# Altium schematic sheet mainboard.schdoc (part 1 of 2) (continued)
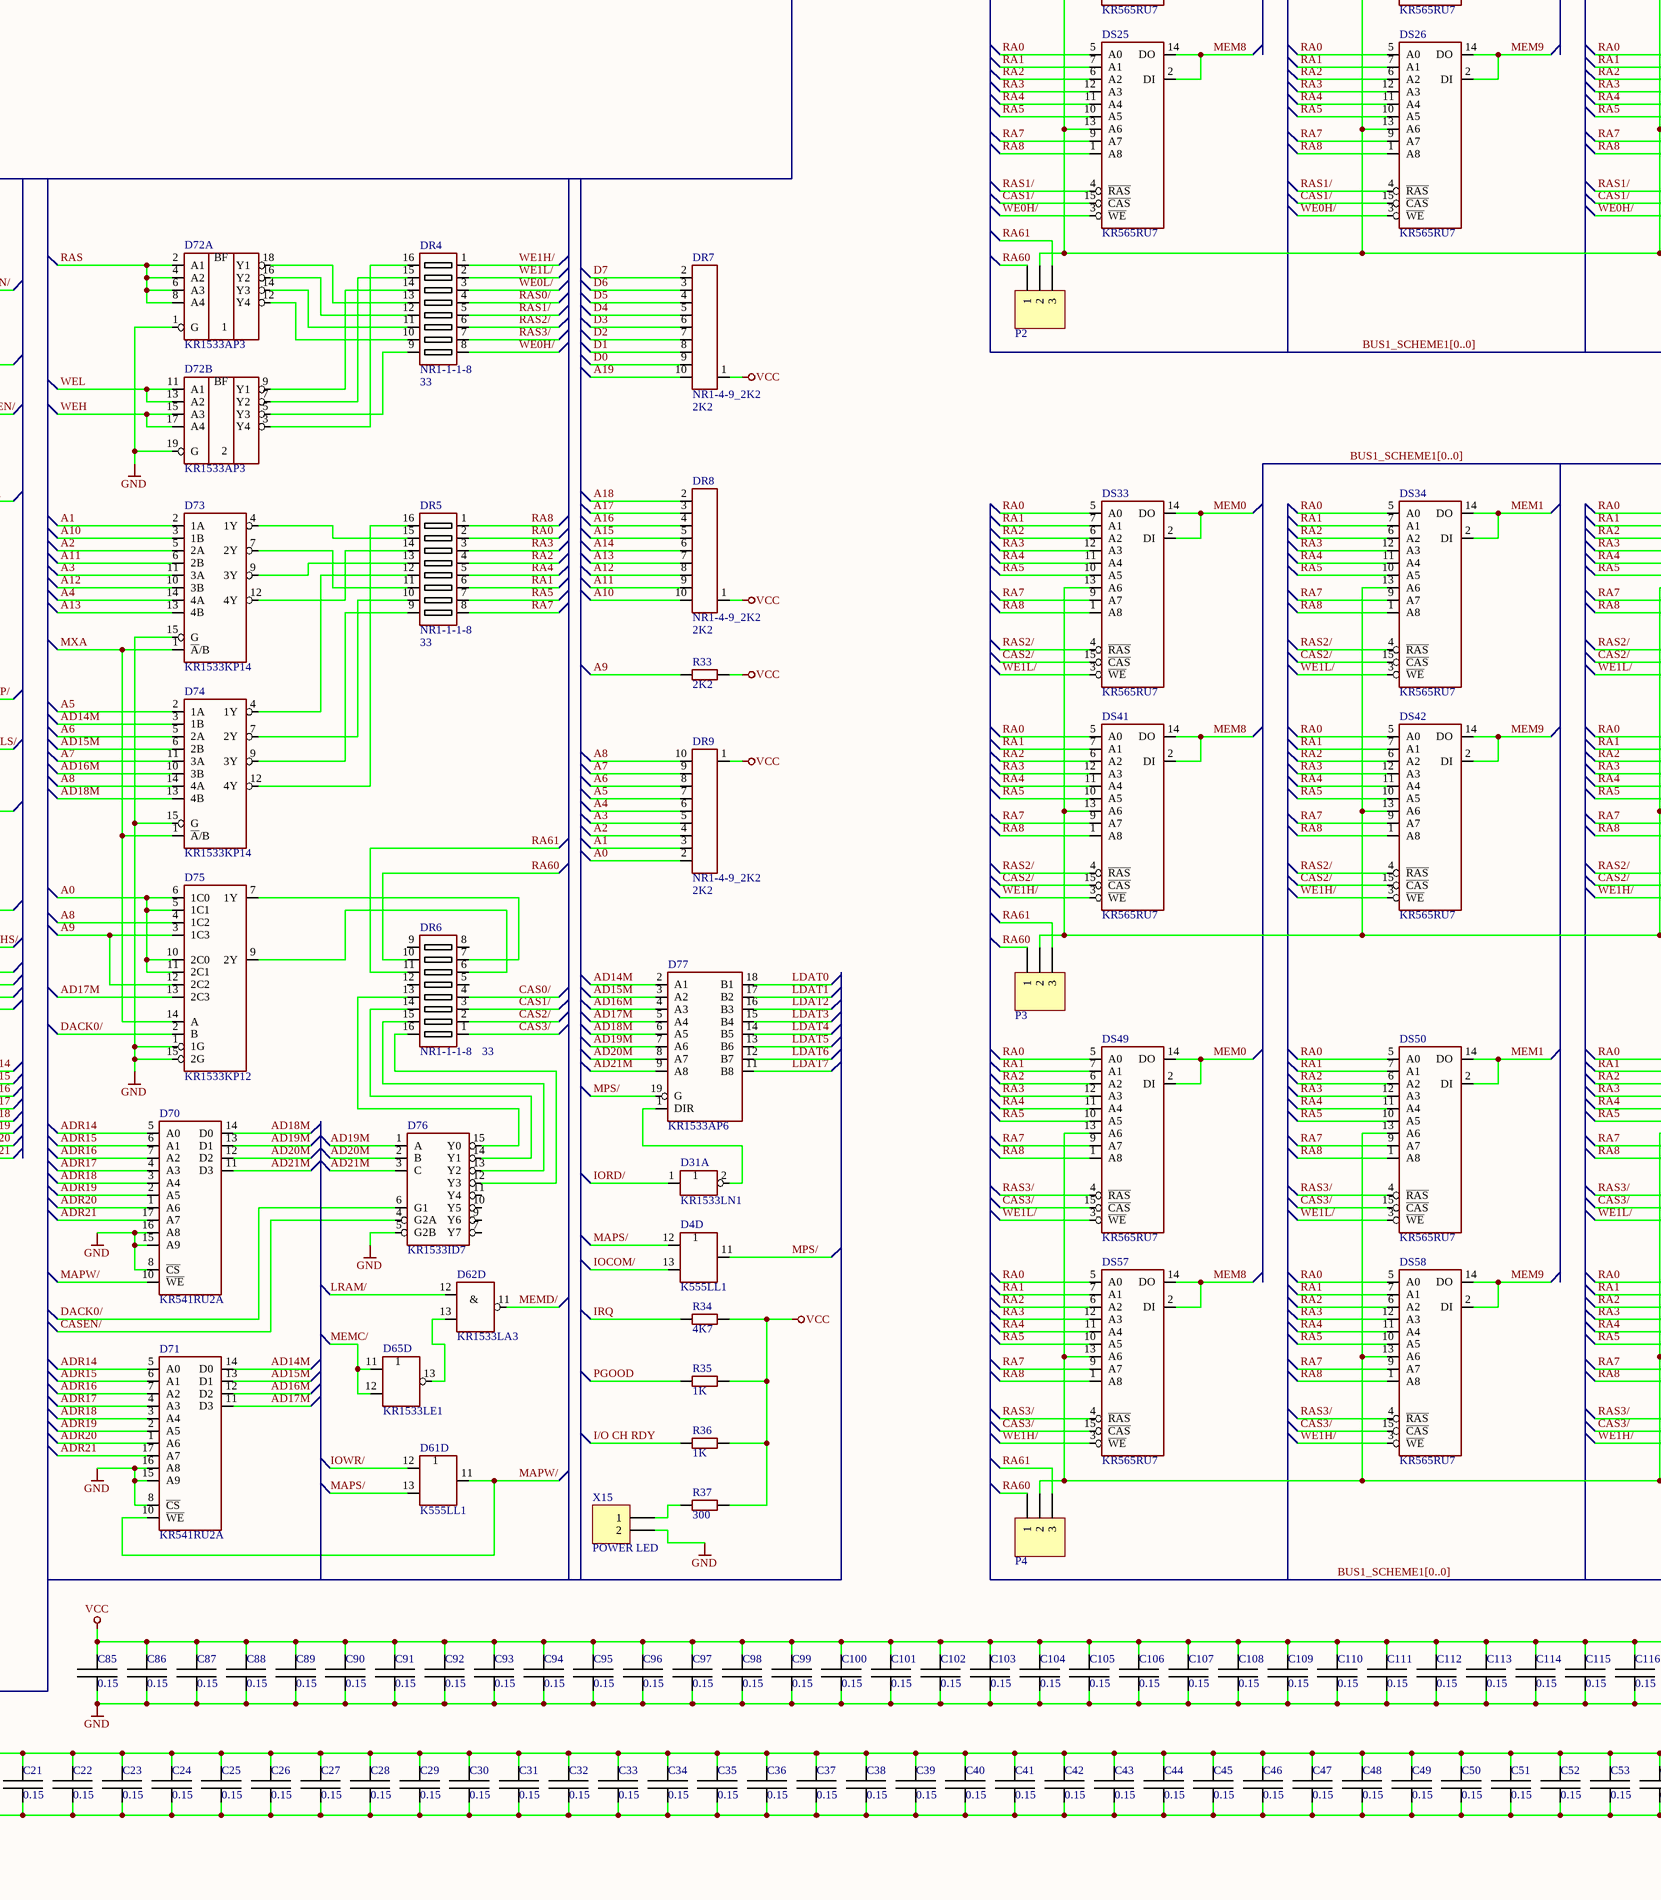
[diagram p4: mainboard.schdoc, bottom middle]
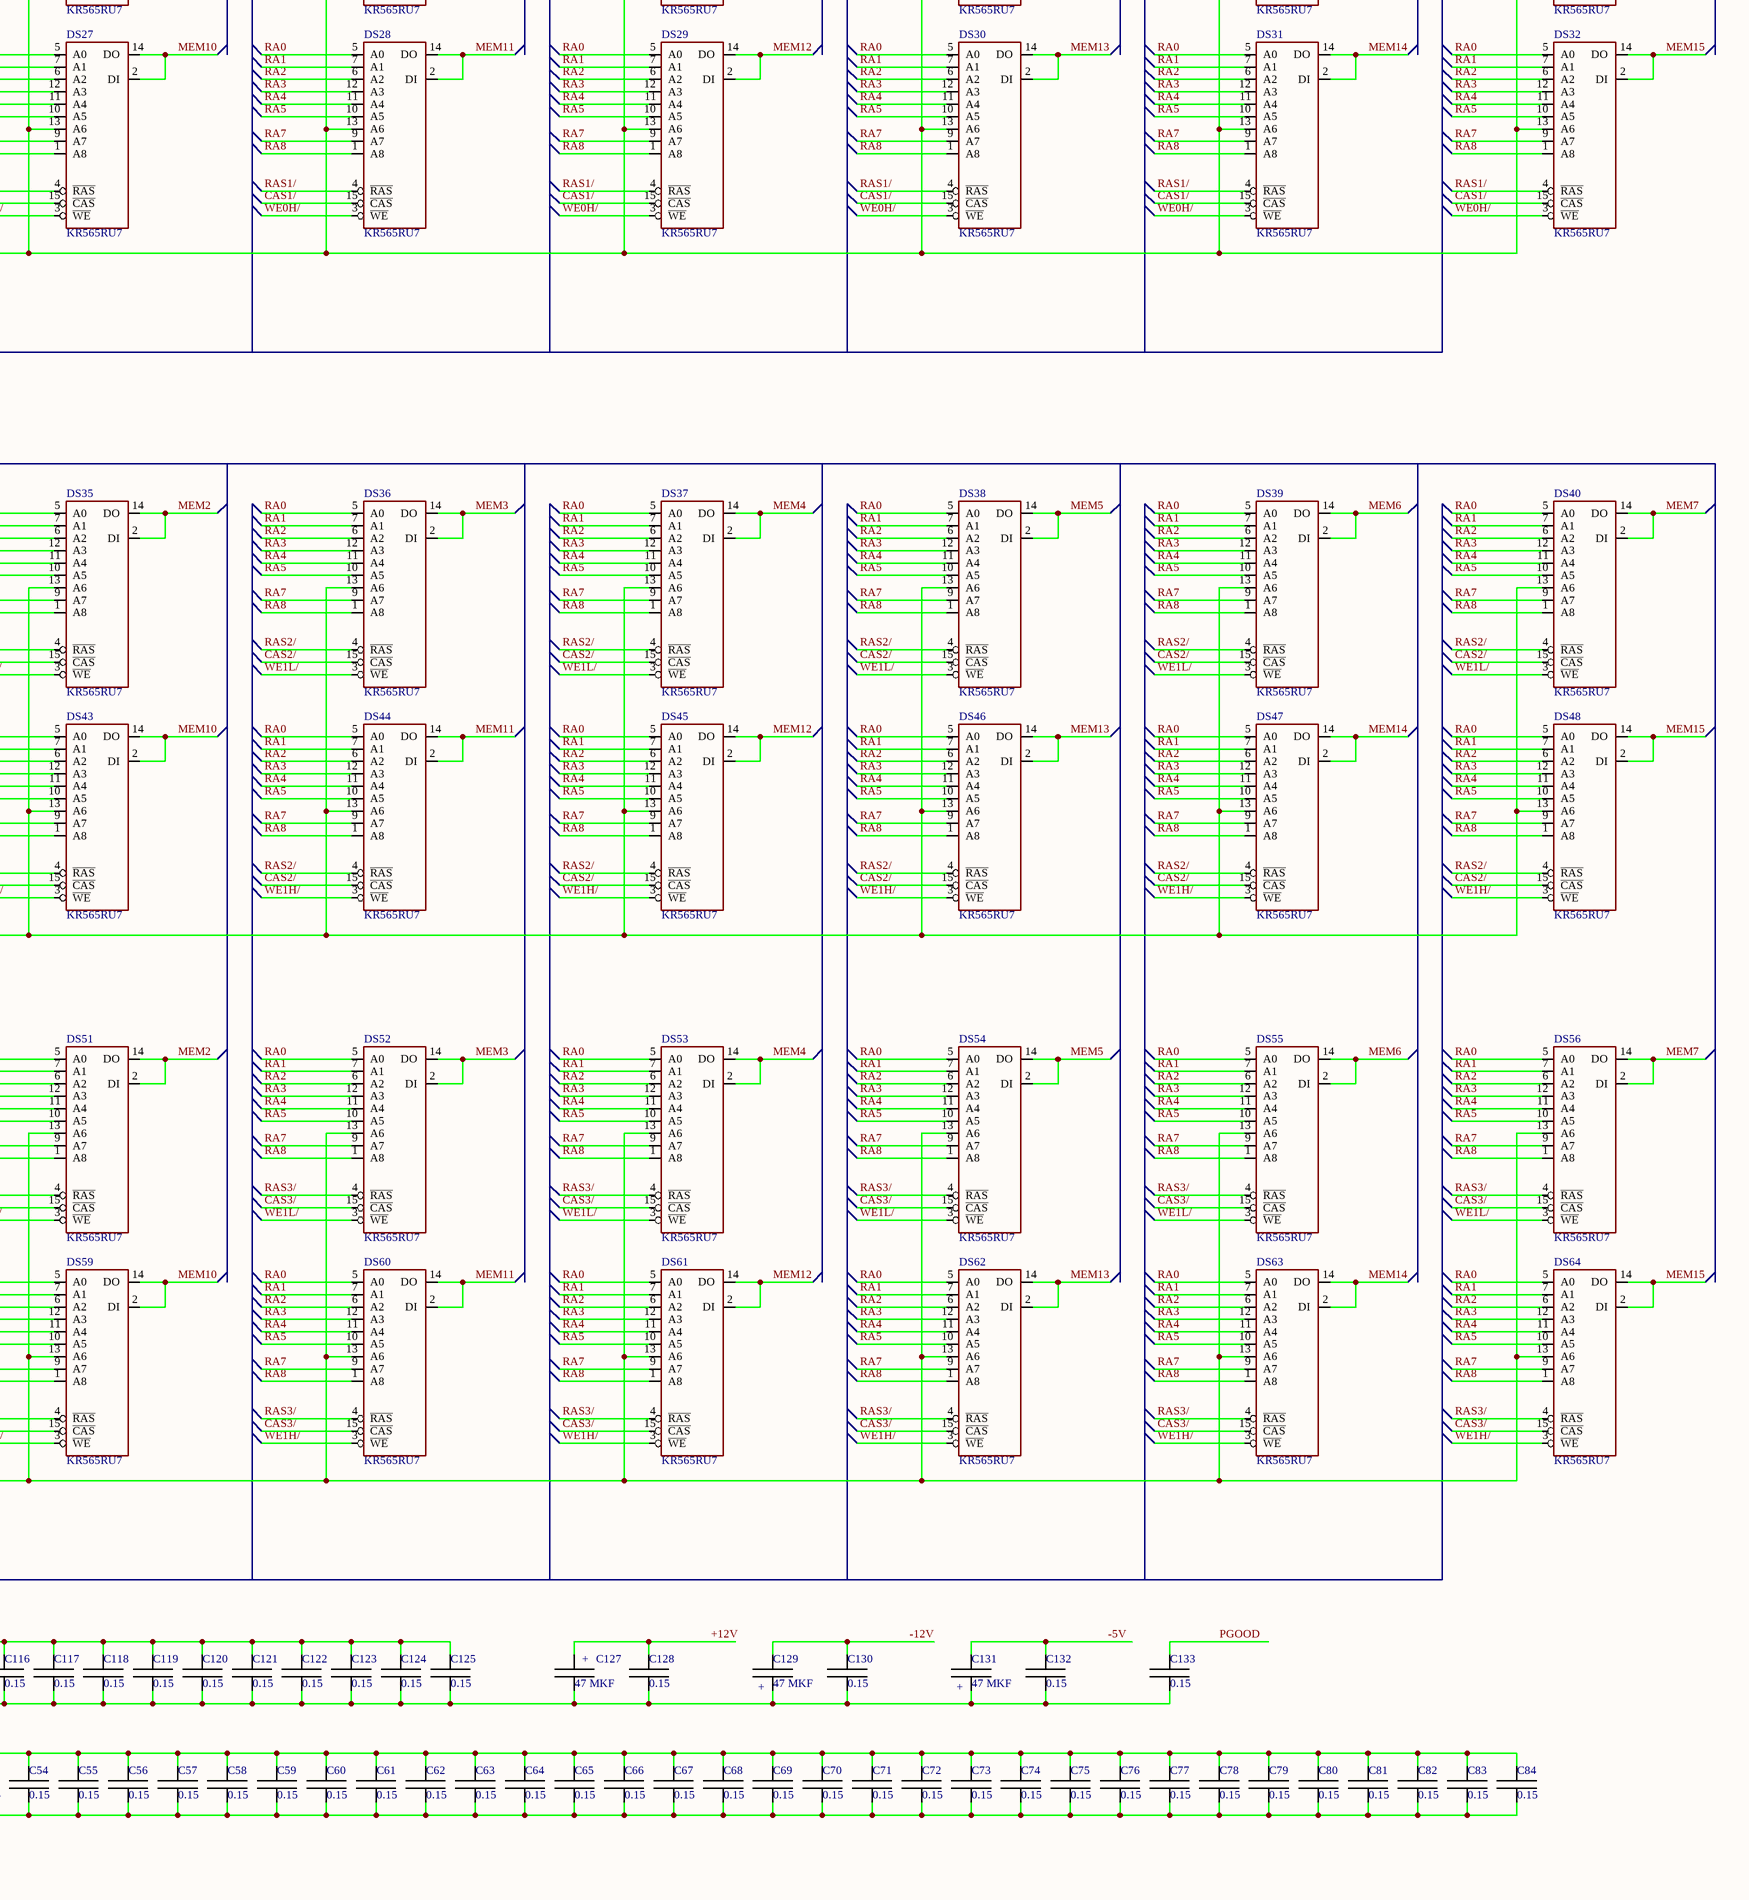
[diagram p5: mainboard.schdoc, bottom right]

## Parts
BT1  BATTERY_6V  [BATTERY_6V]
C1  16pF  [Cap_5mm]
C2  value 39pF  [CAP_2.5MM]  (hidden comment: CAP_39)
C3  22pF  [CAP_2.5MM]
C4  22pF  [CAP_2.5MM]
C5  value 10 MKF  [CAP_20MM_P]  (hidden comment: CAP_10MKF)
C6  6n8  [CAP_2.5MM]
C7  6n8  [CAP_2.5MM]
C8  value 47 MKF  [CAP_25MM_P]  (hidden comment: CAP_47MKF)
C10  value 0.15  [Cap_5mm]  (hidden comment: CAP_0.15)
C11  value 0.15  [Cap_5mm]  (hidden comment: CAP_0.15)
C12  value 0.15  [Cap_5mm]  (hidden comment: CAP_0.15)
C13  value 0.15  [Cap_5mm]  (hidden comment: CAP_0.15)
C14  value 0.15  [Cap_5mm]  (hidden comment: CAP_0.15)
C15  value 0.15  [Cap_5mm]  (hidden comment: CAP_0.15)
C16  value 0.15  [Cap_5mm]  (hidden comment: CAP_0.15)
C17  value 0.15  [Cap_5mm]  (hidden comment: CAP_0.15)
C18  value 0.15  [Cap_5mm]  (hidden comment: CAP_0.15)
C19  value 0.15  [Cap_5mm]  (hidden comment: CAP_0.15)
C20  value 0.15  [Cap_5mm]  (hidden comment: CAP_0.15)
C21  value 0.15  [Cap_5mm]  (hidden comment: CAP_0.15)
C22  value 0.15  [Cap_5mm]  (hidden comment: CAP_0.15)
C23  value 0.15  [Cap_5mm]  (hidden comment: CAP_0.15)
C24  value 0.15  [Cap_5mm]  (hidden comment: CAP_0.15)
C25  value 0.15  [Cap_5mm]  (hidden comment: CAP_0.15)
C26  value 0.15  [Cap_5mm]  (hidden comment: CAP_0.15)
C27  value 0.15  [Cap_5mm]  (hidden comment: CAP_0.15)
C28  value 0.15  [Cap_5mm]  (hidden comment: CAP_0.15)
C29  value 0.15  [Cap_5mm]  (hidden comment: CAP_0.15)
C30  value 0.15  [Cap_5mm]  (hidden comment: CAP_0.15)
C31  value 0.15  [Cap_5mm]  (hidden comment: CAP_0.15)
C32  value 0.15  [Cap_5mm]  (hidden comment: CAP_0.15)
C33  value 0.15  [Cap_5mm]  (hidden comment: CAP_0.15)
C34  value 0.15  [Cap_5mm]  (hidden comment: CAP_0.15)
C35  value 0.15  [Cap_5mm]  (hidden comment: CAP_0.15)
C36  value 0.15  [Cap_5mm]  (hidden comment: CAP_0.15)
C37  value 0.15  [Cap_5mm]  (hidden comment: CAP_0.15)
C38  value 0.15  [Cap_5mm]  (hidden comment: CAP_0.15)
C39  value 0.15  [Cap_5mm]  (hidden comment: CAP_0.15)
C40  value 0.15  [Cap_5mm]  (hidden comment: CAP_0.15)
C41  value 0.15  [Cap_5mm]  (hidden comment: CAP_0.15)
C42  value 0.15  [Cap_5mm]  (hidden comment: CAP_0.15)
C43  value 0.15  [Cap_5mm]  (hidden comment: CAP_0.15)
C44  value 0.15  [Cap_5mm]  (hidden comment: CAP_0.15)
C45  value 0.15  [Cap_5mm]  (hidden comment: CAP_0.15)
C46  value 0.15  [Cap_5mm]  (hidden comment: CAP_0.15)
C47  value 0.15  [Cap_5mm]  (hidden comment: CAP_0.15)
C48  value 0.15  [Cap_5mm]  (hidden comment: CAP_0.15)
C49  value 0.15  [Cap_5mm]  (hidden comment: CAP_0.15)
C50  value 0.15  [Cap_5mm]  (hidden comment: CAP_0.15)
C51  value 0.15  [Cap_5mm]  (hidden comment: CAP_0.15)
C52  value 0.15  [Cap_5mm]  (hidden comment: CAP_0.15)
C53  value 0.15  [Cap_5mm]  (hidden comment: CAP_0.15)
C54  value 0.15  [Cap_5mm]  (hidden comment: CAP_0.15)
C55  value 0.15  [Cap_5mm]  (hidden comment: CAP_0.15)
C56  value 0.15  [Cap_5mm]  (hidden comment: CAP_0.15)
C57  value 0.15  [Cap_5mm]  (hidden comment: CAP_0.15)
C58  value 0.15  [Cap_5mm]  (hidden comment: CAP_0.15)
C59  value 0.15  [Cap_5mm]  (hidden comment: CAP_0.15)
C60  value 0.15  [Cap_5mm]  (hidden comment: CAP_0.15)
C61  value 0.15  [Cap_5mm]  (hidden comment: CAP_0.15)
C62  value 0.15  [Cap_5mm]  (hidden comment: CAP_0.15)
C63  value 0.15  [Cap_5mm]  (hidden comment: CAP_0.15)
C64  value 0.15  [Cap_5mm]  (hidden comment: CAP_0.15)
C65  value 0.15  [Cap_5mm]  (hidden comment: CAP_0.15)
C66  value 0.15  [Cap_5mm]  (hidden comment: CAP_0.15)
C67  value 0.15  [Cap_5mm]  (hidden comment: CAP_0.15)
C68  value 0.15  [Cap_5mm]  (hidden comment: CAP_0.15)
C69  value 0.15  [Cap_5mm]  (hidden comment: CAP_0.15)
C70  value 0.15  [Cap_5mm]  (hidden comment: CAP_0.15)
C71  value 0.15  [Cap_5mm]  (hidden comment: CAP_0.15)
C72  value 0.15  [Cap_5mm]  (hidden comment: CAP_0.15)
C73  value 0.15  [Cap_5mm]  (hidden comment: CAP_0.15)
C74  value 0.15  [Cap_5mm]  (hidden comment: CAP_0.15)
C75  value 0.15  [Cap_5mm]  (hidden comment: CAP_0.15)
C76  value 0.15  [Cap_5mm]  (hidden comment: CAP_0.15)
C77  value 0.15  [Cap_5mm]  (hidden comment: CAP_0.15)
C78  value 0.15  [Cap_5mm]  (hidden comment: CAP_0.15)
C79  value 0.15  [Cap_5mm]  (hidden comment: CAP_0.15)
C80  value 0.15  [Cap_5mm]  (hidden comment: CAP_0.15)
C81  value 0.15  [Cap_5mm]  (hidden comment: CAP_0.15)
C82  value 0.15  [Cap_5mm]  (hidden comment: CAP_0.15)
C83  value 0.15  [Cap_5mm]  (hidden comment: CAP_0.15)
C84  value 0.15  [Cap_5mm]  (hidden comment: CAP_0.15)
C85  value 0.15  [Cap_5mm]  (hidden comment: CAP_0.15)
C86  value 0.15  [Cap_5mm]  (hidden comment: CAP_0.15)
C87  value 0.15  [Cap_5mm]  (hidden comment: CAP_0.15)
C88  value 0.15  [Cap_5mm]  (hidden comment: CAP_0.15)
C89  value 0.15  [Cap_5mm]  (hidden comment: CAP_0.15)
C90  value 0.15  [Cap_5mm]  (hidden comment: CAP_0.15)
C91  value 0.15  [Cap_5mm]  (hidden comment: CAP_0.15)
C92  value 0.15  [Cap_5mm]  (hidden comment: CAP_0.15)
C93  value 0.15  [Cap_5mm]  (hidden comment: CAP_0.15)
C94  value 0.15  [Cap_5mm]  (hidden comment: CAP_0.15)
C95  value 0.15  [Cap_5mm]  (hidden comment: CAP_0.15)
C96  value 0.15  [Cap_5mm]  (hidden comment: CAP_0.15)
C97  value 0.15  [Cap_5mm]  (hidden comment: CAP_0.15)
C98  value 0.15  [Cap_5mm]  (hidden comment: CAP_0.15)
C99  value 0.15  [Cap_5mm]  (hidden comment: CAP_0.15)
C100  value 0.15  [Cap_5mm]  (hidden comment: CAP_0.15)
C101  value 0.15  [Cap_5mm]  (hidden comment: CAP_0.15)
C102  value 0.15  [Cap_5mm]  (hidden comment: CAP_0.15)
C103  value 0.15  [Cap_5mm]  (hidden comment: CAP_0.15)
C104  value 0.15  [Cap_5mm]  (hidden comment: CAP_0.15)
C105  value 0.15  [Cap_5mm]  (hidden comment: CAP_0.15)
C106  value 0.15  [Cap_5mm]  (hidden comment: CAP_0.15)
C107  value 0.15  [Cap_5mm]  (hidden comment: CAP_0.15)
C108  value 0.15  [Cap_5mm]  (hidden comment: CAP_0.15)
C109  value 0.15  [Cap_5mm]  (hidden comment: CAP_0.15)
C110  value 0.15  [Cap_5mm]  (hidden comment: CAP_0.15)
C111  value 0.15  [Cap_5mm]  (hidden comment: CAP_0.15)
C112  value 0.15  [Cap_5mm]  (hidden comment: CAP_0.15)
C113  value 0.15  [Cap_5mm]  (hidden comment: CAP_0.15)
C114  value 0.15  [Cap_5mm]  (hidden comment: CAP_0.15)
C115  value 0.15  [Cap_5mm]  (hidden comment: CAP_0.15)
C116  value 0.15  [Cap_5mm]  (hidden comment: CAP_0.15)
C117  value 0.15  [Cap_5mm]  (hidden comment: CAP_0.15)
C118  value 0.15  [Cap_5mm]  (hidden comment: CAP_0.15)
C119  value 0.15  [Cap_5mm]  (hidden comment: CAP_0.15)
C120  value 0.15  [Cap_5mm]  (hidden comment: CAP_0.15)
C121  value 0.15  [Cap_5mm]  (hidden comment: CAP_0.15)
C122  value 0.15  [Cap_5mm]  (hidden comment: CAP_0.15)
C123  value 0.15  [Cap_5mm]  (hidden comment: CAP_0.15)
C124  value 0.15  [Cap_5mm]  (hidden comment: CAP_0.15)
C125  value 0.15  [Cap_5mm]  (hidden comment: CAP_0.15)
C127  value 47 MKF  [CAP_25MM_P]  (hidden comment: CAP_47MKF)
C128  value 0.15  [Cap_5mm]  (hidden comment: CAP_0.15)
C129  value 47 MKF  [CAP_25MM_P]  (hidden comment: CAP_47MKF)
C130  value 0.15  [Cap_5mm]  (hidden comment: CAP_0.15)
C131  value 47 MKF  [CAP_25MM_P]  (hidden comment: CAP_47MKF)
C132  value 0.15  [Cap_5mm]  (hidden comment: CAP_0.15)
C133  value 0.15  [Cap_5mm]  (hidden comment: CAP_0.15)
C134  value 0.15  [Cap_5mm]  (hidden comment: CAP_0.15)
D1  KR1533TM2  [DIP14]  (parts A,B of 2)
D2  KR1533LA1  [DIP14]  (parts A,B of 2)
D3  KR1533LI1  [DIP14]  (parts A,B,C,D of 4)
D4  K555LL1  [DIP14]  (parts A,C,D of 4)
D5  KR1533TM2  [DIP14]  (parts A,B of 2)
D6  KR1533TM2  [DIP14]  (parts A,B of 2)
D7  KR1533LN1  [DIP14]  (parts C,D,E of 6)
D8  KR1533IE10  [DIP16]
D9  KR1533TM9  [DIP16]
D10  KR1533TM2  [DIP14]  (parts A,B of 2)
D11  KR1533LN1  [DIP14]  (parts A,C of 6)
D12  KR556RT4A  [DIP16]
D13  KR1810GF84  [DIP18]
D14  KR1533LA3  [DIP14]  (parts A,B,C,D of 4)
D15  KR1533LE1  [DIP14]  (parts A,B,C,D of 4)
D16  KR531LN1  [DIP14]  (parts A,B,C,D of 6)
D17  KR1533LI1  [DIP14]  (parts A,B,C,D of 4)
D18  K555LL1  [DIP14]  (parts A,D of 4)
D19  KR531TM2  [DIP14]  (parts A,B of 2)
D20  KR1533TM8  [DIP16]
D21  KR1810VM86M  [DIP40]
D22  KR1810VM87  [DIP40]
D23  KR1533LN1  [DIP14]  (parts A,B,C,D,F of 6)
D24  KR1533LP8  [DIP14]  (parts B,C,D of 4)
D25  KR1533AP5  [DIP20]
D26  KR1533AP6  [DIP20]
D27  KR1533IR22  [DIP20]
D28  KR1533IR22  [DIP20]
D29  KR1533IR22  [DIP20]
D30  KR1810VG88  [DIP20]
D31  KR1533LN1  [DIP14]  (parts A,B,C,D,E,F of 6)
D32  KR556RT4A  [DIP16]
D33  KR1533IR22  [DIP20]
D34  KR1533LI1  [DIP14]  (parts B,D of 4)
D35  KR1533TM2  [DIP14]  (parts A,B of 2)
D36  KR1533TM2  [DIP14]  (parts A,B of 2)
D37  155LA13  [DIP14]  (parts A,B,C,D of 4)
D38  KR1533IR24  [DIP20]
D39  K155IE4  [DIP14]
D40  KR1810VN59A  [DIP28]
D41  KR1533AP6  [DIP20]
D42  K555LL1  [DIP14]  (parts A,B,C,D of 4)
D43  KR1533AP6  [DIP20]
D44  K155ID3  [DIP24]
D45  KR580VV55A  [DIP40]
D46  KR1533AP6  [DIP20]
D47  KR1810VT37  [DIP40]
D48  KM555IR26  [DIP16]
D49  580VI53  [DIP24]
D50  K561LN2  [DIP14]  (parts A,B,C,E,F of 6)
D51  KR1533AP5  [DIP20]
D52  KR1533IR22  [DIP20]
D53  KR1533AP5  [DIP20]
D54  KR512VI1  [DIP24]
D55  KR556RT4A  [DIP16]
D56  KR1533AP6  [DIP20]
D57  KR1533AP6  [DIP20]
D58  KR1533AP6  [DIP20]
D59  27256  [DIP28]
D60  27256  [DIP28]
D61  K555LL1  [DIP14]  (parts A,B,C,D of 4)
D62  KR1533LA3  [DIP14]  (parts A,B,C,D of 4)
D63  KR1533LI1  [DIP14]  (parts A,B,D of 4)
D64  K555LL1  [DIP14]  (parts A,B,C,D of 4)
D65  KR1533LE1  [DIP14]  (parts A,B,C,D of 4)
D66  KR1533TM9  [DIP16]
D67  KR1533AP5  [DIP20]
D68  KM555IR26  [DIP16]
D69  KM555IR26  [DIP16]
D70  KR541RU2A  [DIP18]
D71  KR541RU2A  [DIP18]
D72  KR1533AP3  [DIP20]  (parts A,B of 2)
D73  KR1533KP14  [DIP16]
D74  KR1533KP14  [DIP16]
D75  KR1533KP12  [DIP16]
D76  KR1533ID7  [DIP16]
D77  KR1533AP6  [DIP20]
DR1  NR1-4-9_680  value 680  [NR1-4-9]
DR2  NR1-4-9_680  value 680  [NR1-4-9]
DR3  NR1-4-9_4K7  value 4K7  [NR1-4-9]
DR4  NR1-1-1-8  value 33  [DIP16]
DR5  NR1-1-1-8  value 33  [DIP16]
DR6  NR1-1-1-8  value 33  [DIP16]
DR7  NR1-4-9_2K2  value 2K2  [NR1-4-9ENG]
DR8  NR1-4-9_2K2  value 2K2  [NR1-4-9ENG]
DR9  NR1-4-9_2K2  value 2K2  [NR1-4-9ENG]
DS1  KR565RU7  [DIP16]
DS2  KR565RU7  [DIP16]
DS3  KR565RU7  [DIP16]
DS4  KR565RU7  [DIP16]
DS5  KR565RU7  [DIP16]
DS6  KR565RU7  [DIP16]
DS7  KR565RU7  [DIP16]
DS8  KR565RU7  [DIP16]
DS9  KR565RU7  [DIP16]
DS10  KR565RU7  [DIP16]
DS11  KR565RU7  [DIP16]
DS12  KR565RU7  [DIP16]
DS13  KR565RU7  [DIP16]
DS14  KR565RU7  [DIP16]
DS15  KR565RU7  [DIP16]
DS16  KR565RU7  [DIP16]
DS17  KR565RU7  [DIP16]
DS18  KR565RU7  [DIP16]
DS19  KR565RU7  [DIP16]
DS20  KR565RU7  [DIP16]
DS21  KR565RU7  [DIP16]
DS22  KR565RU7  [DIP16]
DS23  KR565RU7  [DIP16]
DS24  KR565RU7  [DIP16]
DS25  KR565RU7  [DIP16]
DS26  KR565RU7  [DIP16]
DS27  KR565RU7  [DIP16]
DS28  KR565RU7  [DIP16]
DS29  KR565RU7  [DIP16]
DS30  KR565RU7  [DIP16]
DS31  KR565RU7  [DIP16]
DS32  KR565RU7  [DIP16]
DS33  KR565RU7  [DIP16]
DS34  KR565RU7  [DIP16]
DS35  KR565RU7  [DIP16]
DS36  KR565RU7  [DIP16]
DS37  KR565RU7  [DIP16]
DS38  KR565RU7  [DIP16]
DS39  KR565RU7  [DIP16]
DS40  KR565RU7  [DIP16]
DS41  KR565RU7  [DIP16]
DS42  KR565RU7  [DIP16]
DS43  KR565RU7  [DIP16]
DS44  KR565RU7  [DIP16]
DS45  KR565RU7  [DIP16]
DS46  KR565RU7  [DIP16]
DS47  KR565RU7  [DIP16]
DS48  KR565RU7  [DIP16]
DS49  KR565RU7  [DIP16]
DS50  KR565RU7  [DIP16]
DS51  KR565RU7  [DIP16]
DS52  KR565RU7  [DIP16]
DS53  KR565RU7  [DIP16]
DS54  KR565RU7  [DIP16]
DS55  KR565RU7  [DIP16]
DS56  KR565RU7  [DIP16]
DS57  KR565RU7  [DIP16]
DS58  KR565RU7  [DIP16]
DS59  KR565RU7  [DIP16]
DS60  KR565RU7  [DIP16]
DS61  KR565RU7  [DIP16]
DS62  KR565RU7  [DIP16]
DS63  KR565RU7  [DIP16]
DS64  KR565RU7  [DIP16]
P1  Header 3  [HDR1X3]  (value not drawn)
P2  Header 3  [HDR1X3]  (value not drawn)
P3  Header 3  [HDR1X3]  (value not drawn)
P4  Header 3  [HDR1X3]  (value not drawn)
Q1  value 24 MHz  [XTAL_24MHZ]  (hidden comment: XTAL_24MHZ)
Q2  value 14.318 KHz  [XTAL_24MHZ]  (hidden comment: XTAL_14318)
Q3  value 32.768 KHz  [XTAL32768]  (hidden comment: XTAL_32768)
R1  value 1K  [RES_10MM]  (hidden comment: RES_1K)
R2  value 1K  [RES_10MM]  (hidden comment: RES_1K)
R3  value 1K  [RES_10MM]  (hidden comment: RES_1K)
R4  value 1K  [RES_10MM]  (hidden comment: RES_1K)
R5  value 750  [RES_10MM]  (hidden comment: RES_750)
R6  value 750  [RES_10MM]  (hidden comment: RES_750)
R7  value 4K7  [RES_10MM]  (hidden comment: RES_4K7)
R8  value 4K7  [RES_10MM]  (hidden comment: RES_4K7)
R9  value 4K7  [RES_10MM]  (hidden comment: RES_4K7)
R10  value 4K7  [RES_10MM]  (hidden comment: RES_4K7)
R11  value 390  [RES_10MM]  (hidden comment: RES_390)
R12  value 1K  [RES_10MM]  (hidden comment: RES_1K)
R13  value 1K  [RES_10MM]  (hidden comment: RES_1K)
R14  value 1K  [RES_10MM]  (hidden comment: RES_1K)
R15  value 1K  [RES_10MM]  (hidden comment: RES_1K)
R16  value 390  [RES_10MM]  (hidden comment: RES_390)
R17  value 10K  [RES_10MM]  (hidden comment: RES_10K)
R18  value 10K  [RES_10MM]  (hidden comment: RES_10K)
R19  value 100  [RES_10MM]  (hidden comment: RES_100)
R20  value 51K  [RES_10MM]  (hidden comment: RES_51K)
R21  value 10K  [RES_10MM]  (hidden comment: RES_10K)
R22  value 5M1  [RES_12.5MM]  (hidden comment: RES_5M1)
R23  value 1K  [RES_10MM]  (hidden comment: RES_1K)
R24  value 470K  [RES_10MM]  (hidden comment: RES_470K)
R25  value 4K7  [RES_10MM]  (hidden comment: RES_4K7)
R26  value 10K  [RES_10MM]  (hidden comment: RES_10K)
R27  value 1K  [RES_10MM]  (hidden comment: RES_1K)
R28  value 680  [RES_10MM]  (hidden comment: RES_680)
R29  value 680  [RES_10MM]  (hidden comment: RES_680)
R30  value 680  [RES_10MM]  (hidden comment: RES_680)
R31  value 680  [RES_10MM]  (hidden comment: RES_680)
R32  value 1K  [RES_10MM]  (hidden comment: RES_1K)
R33  value 2K2  [RES_10MM]  (hidden comment: RES_2K2)
R34  value 4K7  [RES_10MM]  (hidden comment: RES_4K7)
R35  value 1K  [RES_10MM]  (hidden comment: RES_1K)
R36  value 1K  [RES_10MM]  (hidden comment: RES_1K)
R37  value 300  [RES_10MM]  (hidden comment: RES_300)
R38  value 1K  [RES_10MM]  (hidden comment: RES_1K)
S1  Header 2X2  [HDR2X2]
S6  HEADER4X2  [HEADER4X2]  (value not drawn)
S7  Header 2  [HDR1X2]
VD1  KD522A  [DIOD_12.5]
VD2  KD522A  [DIOD_12.5]
VT1  KT361A  [TRANS]
VT2  KT315G  [TRANS]
X1  RESET  [HDR1X2]
X2  SPEAKER  [HDR1X2]
X3  KEYB LOCK  [HDR1X2]
X4  Keyboard  [DN-5J]
X5  POWER SUPPLY  [P8P9_12A]
X7  SlotISA8Bit  [ISA8bit]
X8  SlotISA8Bit  [ISA8bit]
X9  SlotISA8Bit  [ISA8bit]
X10  SlotISA8Bit  [ISA8bit]
X11  SlotISA8Bit  [ISA8bit]
X12  SlotISA8Bit  [ISA8bit]
X13  SlotISA8Bit  [ISA8bit]
X14  SlotISA8Bit  [ISA8bit]
X15  POWER LED  [HDR1X2]